# Altium schematic sheet PROM21参考.schdoc (continued)
## Nets (continued)
P3V3: D1.2(+) F1.A9(+3.3V) F1.A10(+3.3V) F1.B8(+3.3V) Q5.2(S) R89.2
P3V3_AUX: D2.2(+) F1.B10(+3.3Vaux)
P12V: C12.2 C13.2 C21.2 C22.2 C33.2 C34.2 C42.2 C43.2 C51.1 C52.2 C53.2 F1.A2(+12V) F1.A3(+12V) F1.B1(+12V) F1.B2(+12V) F1.B3(+12V) R55.2 R62.2 U2.3(VIN) U3.3(VIN) U3.5(EN) U5.3(VIN) U6.3(VIN) U7.2(VIN) U7.3(VIN) U7.4(VIN) U7.5(VIN)
VBUSA: C23.2 C24.2 C25.2 C26.2 C27.1 C28.1 C131.2 L2.2 R58.1 R107.1 R108.1 R109.1 R110.1 U11.12(VDD) USB1.1(VBUS) USB1.7(VBUS) USB1.11(VBUS)
VCC18: C44.2 C45.2 C46.2 C47.2 C48.1 C81.2 C82.2 C83.2 C84.2 C85.2 C86.2 C87.2 C88.2 C89.2 C90.2 L4.2 R65.2 R91.2 U8.A5(VCC18) U8.A6(VCC18) U8.B5(VCC18) U8.B6(VCC18) U8.C6(VCC18) U8.C7(VCC18) U8.D6(VCC18) U8.D7(VCC18) U8.E6(VCC18) U8.J9(VCC18) U8.J10(VCC18) U8.J11(VCC18) U8.J13(VCC18) U8.J14(VCC18) U8.J15(VCC18) U8.K9(VCC18) U8.K15(VCC18) U8.L9(VCC18) U8.L15(VCC18) U8.M9(VCC18) U8.M15(VCC18) U8.N15(VCC18) U8.P15(VCC18) U8.R9(VCC18) U8.R10(VCC18) U8.R11(VCC18) U8.R12(VCC18) U8.R13(VCC18) U8.R14(VCC18)
VCC33: C73.2 C74.2 C75.2 C76.2 LED1.2(A) LED2.2(A) LED3.2(A) LED4.2(A) Q1.2(E) Q2.2(E) Q5.3(D) R14.2 R16.2 R17.2 R20.2 R22.2 R24.2 R26.2 R28.2 R30.2 R32.2 R34.2 R36.2 R38.2 R40.2 R44.2 R45.2 R46.2 R47.2 R52.1 R67.2 R81.1 R92.2 R93.2 R111.2 R112.2 R113.2 U6.5(EN) U7.12(EN) U8.F10(VCC33) U8.F16(VCC33) U8.R18(VCC33)
VDD105: C55.2 C56.2 C57.2 C58.2 C59.1 C60.1 C103.2 C104.2 C105.2 C106.2 C107.2 C108.2 C109.2 C110.2 C111.2 C112.2 C113.2 C114.2 C115.2 C116.2 L5.2 R77.2 U8.J12(VDD105) U8.K10(VDD105) U8.K11(VDD105) U8.K13(VDD105) U8.K14(VDD105) U8.L10(VDD105) U8.L12(VDD105) U8.L14(VDD105) U8.M11(VDD105) U8.M13(VDD105) U8.N9(VDD105) U8.N10(VDD105) U8.N12(VDD105) U8.N14(VDD105) U8.P9(VDD105) U8.P10(VDD105) U8.P11(VDD105) U8.P13(VDD105) U8.P14(VDD105) U8.R1(VDD105) U8.R2(VDD105) U8.R3(VDD105) U8.R4(VDD105) U8.R5(VDD105) U8.R6(VDD105) U8.R15(VDD105) U8.T1(VDD105) U8.T2(VDD105) U8.T3(VDD105) U8.T4(VDD105) U8.T5(VDD105) U8.T6(VDD105)
VPP: C10.1 R51.2 R52.2 R53.2 R54.1 U1.8(VCC)
VSUS33: C30.2 C77.2 C78.2 D1.1(-) D2.1(-) R4.2 R5.2 R6.2 R7.2 R8.2 R9.2 R11.2 R13.2 R51.1 R66.2 U4.1(VIN) U4.3(EN) U8.P7(VSUS33)
VSUS105: C32.2 C79.2 C80.2 R60.2 R98.1 U4.6(VOUT) U8.U6(VSUS105)
1V05_PG: Q7.1(B) R91.1 U7.9(PGOOD)
ACT1: M.2-1.10(DAS_DSS#) R69.1
ACT2: M.2-2.10(DAS_DSS#) R70.1
C0+: C117.1 M.2-1.47(PETN0/SATA_A-)
C0-: C118.1 M.2-1.49(PETP0/SATA_A+)
C1+: C98.1 M.2-1.35(PETN1)
C1-: C100.1 M.2-1.37(PETP1)
C2+: C91.1 M.2-1.23(PETN2)
C2-: C92.1 M.2-1.25(PETP2)
C3+: C67.1 M.2-1.11(PETN3)
C3-: C68.1 M.2-1.13(PETP3)
C4+: C119.1 M.2-2.47(PETN0/SATA_A-)
C4-: C120.1 M.2-2.49(PETP0/SATA_A+)
C5+: C101.1 M.2-2.35(PETN1)
C5-: C102.1 M.2-2.37(PETP1)
C6+: C93.1 M.2-2.23(PETN2)
C6-: C94.1 M.2-2.25(PETP2)
C7+: C69.1 M.2-2.11(PETN3)
C7-: C70.1 M.2-2.13(PETP3)
CC1: R103.2 R105.2 USB1.8(CC1)
CC2: R104.2 R106.2 USB1.20(CC2)
CC_IND0: R113.1 U8.AB10(CC_IND_0) U11.11(DIR)
CLK0+: M.2-1.55(REFCLK+) U8.A21(CLK0+)
CLK0-: M.2-1.53(REFCLK-) U8.B21(CLK0-)
CLK1+: U8.A20(CLK1+)
CLK1-: U8.B20(CLK1-)
CLK2+: U8.A19(CLK2+)
CLK2-: U8.B19(CLK2-)
CLK3+: U8.D17(CLK3+)
CLK3-: U8.E17(CLK3-)
CLK4+: M.2-2.55(REFCLK+) U8.A18(CLK4+)
CLK4-: M.2-2.53(REFCLK-) U8.B18(CLK4-)
CLK5+: U8.A17(CLK5+)
CLK5-: U8.B17(CLK5-)
CLK_SRC: R16.1 R18.2 U8.E19(GPIO_R2*)  [also labelled GPIO_R2]
CLKREQ: R3.1 U8.A23(CLKREQ#)
CLKREQ0: M.2-1.52(CLKREQ#) R48.1 U8.AB22(GPIO18)
CLKREQ1: R44.1 U8.AA21(GPIO19)
CLKREQ2: R45.1 U8.V22(GPIO20)
CLKREQ3: R46.1 U8.AC21(GPIO21)
CLKREQ4: M.2-2.52(CLKREQ#) R49.1 U8.W22(GPIO22)
CLKREQ5: R47.1 U8.Y23(GPIO23)
DPE_RX0+: M.2-1.43(PERP0/SATA_B-) U8.K20(DPE_RX0+)
DPE_RX0-: M.2-1.41(PERN0/SATA_B+) U8.K19(DPE_RX0-)
DPE_RX1+: M.2-1.29(PERN1) U8.L20(DPE_RX1+)
DPE_RX1-: M.2-1.31(PERP1) U8.L19(DPE_RX1-)
DPE_RX2+: M.2-1.19(PERP2) U8.N20(DPE_RX2+)
DPE_RX2-: M.2-1.17(PERN2) U8.N19(DPE_RX2-)
DPE_RX3+: M.2-1.5(PERN3) U8.P20(DPE_RX3+)
DPE_RX3-: M.2-1.7(PERP3) U8.P19(DPE_RX3-)
DPE_RX4+: C66.1 U8.D8(DPE_RX4+)
DPE_RX4-: C64.1 U8.E8(DPE_RX4-)
DPE_RX5+: C99.1 U8.D9(DPE_RX5+)
DPE_RX5-: C97.1 U8.E9(DPE_RX5-)
DPE_RX6+: C124.1 U8.D11(DPE_RX6+)
DPE_RX6-: C123.1 U8.E11(DPE_RX6-)
DPE_RX7+: C130.1 U8.D12(DPE_RX7+)
DPE_RX7-: C129.1 U8.E12(DPE_RX7-)
DPE_RX8+: M.2-2.43(PERP0/SATA_B-) U8.D14(DPE_RX8+)
DPE_RX8-: M.2-2.41(PERN0/SATA_B+) U8.E14(DPE_RX8-)
DPE_RX9+: M.2-2.29(PERN1) U8.D15(DPE_RX9+)
DPE_RX9-: M.2-2.31(PERP1) U8.E15(DPE_RX9-)
DPE_RX10+: M.2-2.19(PERP2) U8.G20(DPE_RX10+)
DPE_RX10-: M.2-2.17(PERN2) U8.G19(DPE_RX10-)
DPE_RX11+: M.2-2.5(PERN3) U8.H20(DPE_RX11+)
DPE_RX11-: M.2-2.7(PERP3) U8.H19(DPE_RX11-)
DPE_TX0+: C118.2 U8.K22(DPE_TX0+)
DPE_TX0-: C117.2 U8.K23(DPE_TX0-)
DPE_TX1+: C100.2 U8.L22(DPE_TX1+)
DPE_TX1-: C98.2 U8.L23(DPE_TX1-)
DPE_TX2+: C92.2 U8.N22(DPE_TX2+)
DPE_TX2-: C91.2 U8.N23(DPE_TX2-)
DPE_TX3+: C68.2 U8.P22(DPE_TX3+)
DPE_TX3-: C67.2 U8.P23(DPE_TX3-)
DPE_TX4+: C61.1 U8.B8(DPE_TX4+)
DPE_TX4-: C62.1 U8.A8(DPE_TX4-)
DPE_TX5+: C95.1 U8.B9(DPE_TX5+)
DPE_TX5-: C96.1 U8.A9(DPE_TX5-)
DPE_TX6+: C121.1 U8.B11(DPE_TX6+)
DPE_TX6-: C122.1 U8.A11(DPE_TX6-)
DPE_TX7+: C127.1 U8.B12(DPE_TX7+)
DPE_TX7-: C128.1 U8.A12(DPE_TX7-)
DPE_TX8+: C120.2 U8.B14(DPE_TX8+)
DPE_TX8-: C119.2 U8.A14(DPE_TX8-)
DPE_TX9+: C102.2 U8.B15(DPE_TX9+)
DPE_TX9-: C101.2 U8.A15(DPE_TX9-)
DPE_TX10+: C94.2 U8.G22(DPE_TX10+)
DPE_TX10-: C93.2 U8.G23(DPE_TX10-)
DPE_TX11+: C70.2 U8.H22(DPE_TX11+)
DPE_TX11-: C69.2 U8.H23(DPE_TX11-)
EFUSE_PWR: U8.U20(EFUSE_PWR)
FAN_CTRL: R32.1 R35.2 U8.AB23(*FAN_CTRL)  [also labelled G1S1]
G0S0: R40.1 R42.2 U8.C2(*UART_TX)  [also labelled UART_TX]
G0S1: R38.1 R41.2 U1.2(SO) U8.A4(*SPI_SDI)  [also labelled SPI_SDI]
G0S2: R36.1 R39.2 U1.5(SI) U8.E2(*SPI_SDO)  [also labelled SPI_SDO]
G1S0: R34.1 R37.2 U8.E18(GPIO_R1*)  [also labelled GPIO_R1]
G1S2: R30.1 R33.2 U8.A22(*INT)  [also labelled GPIO_INT]
G2S0: R28.1 R31.2 U1.6(SCK) U8.A1(*SPI_SCL)  [also labelled SPI_SCK]
G2S1: R26.1 R29.2 U8.C1(GPIO_R9*)  [also labelled GPIO_R9]
G2S2: R24.1 R27.2 U8.B1(GPIO_R8*)  [also labelled GPIO_R8]
GPIO0: U8.B3(GPIO0)
GPIO1: U8.C4(GPIO1)
GPIO2: U8.A2(GPIO2)
GPIO3: U8.D3(GPIO3)
GPIO4: U8.D2(GPIO4)
GPIO5: U8.B4(GPIO5)
GPIO6: U8.C3(GPIO6)
GPIO7: U8.D4(GPIO7)
GPIO8: U8.D22(GPIO8)
GPIO9: U8.B22(GPIO9)
GPIO10: U8.C23(GPIO10)
GPIO11: U8.C19(GPIO11)
GPIO12: U8.D19(GPIO12)
GPIO13: U8.AB21(GPIO13)
GPIO14: U8.Y21(GPIO14)
GPIO15: U8.V20(GPIO15)
GPIO16: U8.V21(GPIO16)
GPIO17: U8.AA23(GPIO17)
GPIO_R0: U8.E20(GPIO_R0)
GPIO_R3: R17.1 R21.2 U8.D20(GPIO_R3*)  [also labelled USB_SSC_EN]
GPIO_R4: R20.1 R23.2 U8.B23(GPIO_R4*)  [also labelled SATA_SSC_EN]
GPIO_R5: R22.1 R25.2 U8.D18(GPIO_R5*)  [also labelled PCIE_SSC_EN]
GPIO_R6: U8.D21(GPIO_R6)
GPIO_R7: U8.C22(GPIO_R7)
IFDET0: R10.1 U8.E3(IFDET0)
IFDET1: R12.1 U8.E4(IFDET1)
INT: R81.2 U8.V23(INT)
M2_RST: M.2-1.50(PERST#) M.2-2.50(PERST#) Q4.3(D) R67.1
PERST: R2.1 U8.AC5(PERST)
PEWAKE: R1.1 U8.AC6(PEWAKE)
PON0: U8.AC10(PPON_0)
PON1: U8.AB9(PPON_2)
PON2: U8.AB8(PPON_2)
PON3: U8.AB7(PPON_3)
PON4: U8.W8(PPON_4)
PON5: U8.AA6(PPON_5)
PON6: U8.W6(PPON_6)
PON7: U8.AA5(PPON_7)
PON8: U8.Y8(PPON_8)
PON9: U8.AB6(PPON_9)
PON10: U8.Y7(PPON_10)
PON11: R14.1 R19.2 U8.AB5(PPON_11)
PREXT: R50.2 U8.D23(PREXT)
PWR_GD: C126.2 Q8.3(D) R93.1 U8.U22(PWR_GD)
REFCLK+: F1.A13(REFCLKp) U8.E22(UPE_CLK0-)
REFCLK-: F1.A14(REFCLKn) U8.E23(UPE_CLK+)
RST: Q3.1(G) U8.AC7(RST)
S0+: C61.2 CN1.2
S0-: C62.2 CN1.3
S1+: C64.2 CN1.5
S1-: C66.2 CN1.6
S2+: C95.2 CN2.2
S2-: C96.2 CN2.3
S3+: C97.2 CN2.5
S3-: C99.2 CN2.6
S4+: C121.2 CN3.2
S4-: C122.2 CN3.3
S5+: C123.2 CN3.5
S5-: C124.2 CN3.6
S6+: C127.2 CN4.2
S6-: C128.2 CN4.3
S7+: C129.2 CN4.5
S7-: C130.2 CN4.6
SATA_LED0: R71.1 U8.A3(SATALED0)
SATA_LED1: R72.1 U8.C5(SATALED1)
SATA_LED2: R75.1 U8.E5(SATALED2)
SATA_LED3: R76.1 U8.D1(SATALED3)
SMI: U8.D5(SMI)
SPI_CS: U1.1(CS#) U8.E1(SPI_CS)
SS0_RX+: U8.W12(SS_RXP0) USB1.5(RX1+)
SS0_RX-: U8.Y12(SS_RXN0) USB1.6(RX1-)
SS0_TX+: C63.1 U8.AB12(SS_TXP0)
SS0_TX-: C65.1 U8.AC12(SS_TXN0)
SS1_RX+: U8.Y13(SS_RXP1) USB1.16(RX2-)
SS1_RX-: U8.W13(SS_RXN1) USB1.15(RX2+)
SS1_TX+: C49.1 U8.AC13(SS_TXP1)
SS1_TX-: C50.1 U8.AB13(SS_TXN1)
SS2_RX+: U8.W15(SS_RXP2)
SS2_RX-: U8.Y15(SS_RXN2)
SS2_TX+: U8.AB15(SS_TXP2)
SS2_TX-: U8.AC15(SS_TXN2)
SS3_RX+: U8.W16(SS_RXP3)
SS3_RX-: U8.Y16(SS_RXN3)
SS3_TX+: U8.AB16(SS_TXP3)
SS3_TX-: U8.AC16(SS_TXN3)
SS4_RX+: U8.W18(SS_RXP4)
SS4_RX-: U8.Y18(SS_RXN4)
SS4_TX+: U8.AB18(SS_TXP4)
SS4_TX-: U8.AC18(SS_TXN4)
SS5_RX+: U8.W19(SS_RXP5)
SS5_RX-: U8.Y19(SS_RXN5)
SS5_TX+: U8.AB19(SS_TXP5)
SS5_TX-: U8.AC19(SS_TXN5)
STATUS0: R111.1 R114.1 U8.AA10(STATUS_IND_0)
STATUS1: R112.1 R115.1 U8.Y10(STATUS_IND2_0)
TACH_IN: U8.AC22(TACH_IN)
TCK: U8.W23(*TCK)
TDI: U8.AC23(TDI)
TDO: U8.AA22(*TDO)
TMS: U8.W21(TMS)
TRST: R43.2 U8.Y22(RTCK)
U3C0+: C65.2 USB1.2(TX1+)
U3C0-: C63.2 USB1.3(TX1-)
U3C1+: C49.2 USB1.12(TX2+)
U3C1-: C50.2 USB1.13(TX2-)
UART_RX: U8.B2(UART_RX)
UPE_RX0+: F1.B15(PERn0) U8.G4(UPE_RX0+)
UPE_RX0-: F1.B14(PERp0) U8.G5(UPE_RX0-)
UPE_RX1+: F1.B20(PERn1) U8.J4(UPE_RX1+)
UPE_RX1-: F1.B19(PERp1) U8.J5(UPE_RX1-)
UPE_RX2+: F1.B24(PERn2) U8.L4(UPE_RX2+)
UPE_RX2-: F1.B23(PERp2) U8.L5(UPE_RX2-)
UPE_RX3+: F1.B28(PERn3) U8.N4(UPE_RX3+)
UPE_RX3-: F1.B27(PERp3) U8.N5(UPE_RX3-)
UPE_TX0+: C2.2 U8.G2(UPE_TX0+)
UPE_TX0-: C3.2 U8.G1(UPE_TX0-)
UPE_TX1+: C4.2 U8.J2(UPE_TX1+)
UPE_TX1-: C5.2 U8.J1(UPE_TX1-)
UPE_TX2+: C6.2 U8.L2(UPE_TX2+)
UPE_TX2-: C7.2 U8.L1(UPE_TX2-)
UPE_TX3+: C8.2 U8.N2(UPE_TX3+)
UPE_TX3-: C9.2 U8.N1(UPE_TX3-)
UREXT: R15.1 U8.U23(UREXT)
USB0_D+: U8.U1(HSDP0) USB1.19(D+)
USB0_D-: U8.U2(HSDN0) USB1.18(D-)
USB1_D+: U8.U5(HSDP1)
USB1_D-: U8.U4(HSDN1)
USB2_D+: U8.V2(HSDP2)
USB2_D-: U8.W1(HSDN2)
USB3_D+: U8.V3(HSDP3)
USB3_D-: U8.V4(HSDN3)
USB4_D+: U8.Y1(HSDP4)
USB4_D-: U8.W2(HSDN4)
USB5_D+: U8.AA2(HSDP5)
USB5_D-: U8.AA1(HSDN5)
USB6_D+: U8.Y3(HSDP6)
USB6_D-: U8.W3(HSDN6)
USB7_D+: U8.AB1(HSDP7)
USB7_D-: U8.AB2(HSDN7)
USB8_D+: U8.Y4(HSDP8)
USB8_D-: U8.Y5(HSDN8)
USB9_D+: U8.AA4(HSDP9)
USB9_D-: U8.AA3(HSDN9)
USB10_D+: U8.AC3(HSDP10)
USB10_D-: U8.AC2(HSDN10)
USB11_D+: U8.AB4(HSDP11)
USB11_D-: U8.AC4(HSDN11)
USB_OC0: R4.1 U8.AC9(USB_OC0)
USB_OC1: R5.1 U8.W7(USB_OC1)
USB_OC2: R6.1 U8.Y6(USB_OC2)
USB_OC3: R7.1 U8.AC8(USB_OC3)
USB_OC4: R8.1 U8.Y9(USB_OC4)
USB_OC5: R9.1 U8.AA8(USB_OC5)
USB_OC6: R11.1 U8.AA7(USB_OC6)
USB_OC7: R13.1 U8.AA9(USB_OC7)
VTEST: U8.E21(V_TEST)
X1: C1.2 U8.T22(X1) X1.3(OSC2)
X2: C1.1 U8.T23(X2) X1.1(OSC1)
NetC11_1: C11.1 L1.1 U2.2(SW)
NetC11_2: C11.2 U2.6(VBST)
NetC14_1: C14.1 L2.1 U3.2(SW)
NetC14_2: C14.2 U3.6(VBST)
NetC29_1: C29.1 L3.1 U5.2(SW)
NetC29_2: C29.2 U5.6(VBST)
NetC31_2: C31.2 U4.4(BP)
NetC41_1: C41.1 L4.1 U6.2(SW)
NetC41_2: C41.2 U6.6(VBST)
NetC54_1: C54.1 U7.1(BST)
NetC54_2: C54.2 L5.1 U7.6(SW) U7.19(SW) U7.20(SW)
NetC71_2: C71.2 R78.1 U7.17(VCC)
NetC72_2: C72.2 U7.11(SS)
NetC125_2: C125.2 Q6.1(B) R98.2
NetF1_A11: F1.A11(PERST#) R2.2
NetF1_B11: F1.B11(WAKE#) R1.2
NetF1_B12: F1.B12(CLKREQ#) R3.2
NetLED1_1: LED1.1(K) R71.2
NetLED2_1: LED2.1(K) R72.2
NetLED3_1: LED3.1(K) R75.2
NetLED4_1: LED4.1(K) R76.2
NetLED5_2: LED5.2(A) R73.1
NetLED6_2: LED6.2(A) R74.1
NetQ1_1: Q1.1(B) R69.2
NetQ1_3: Q1.3(C) R73.2
NetQ2_1: Q2.1(B) R70.2
NetQ2_3: Q2.3(C) R74.2
NetQ3_3: Q3.3(D) Q4.1(G) R66.1
NetQ5_1: Q5.1(G) Q6.3(C) R89.1
NetQ7_3: Q7.3(C) Q8.1(G) R92.1
NetR53_1: R53.1 U1.3(WP#)
NetR54_2: R54.2 U1.7(HOLD#)
NetR55_1: R55.1 U2.5(EN)
NetR56_1: R56.1 R57.1 U2.4(VFB)
NetR58_2: R58.2 R59.2 U3.4(VFB)
NetR60_1: R60.1 R61.2 U4.5(ADJ)
NetR62_1: R62.1 U5.5(EN)
NetR63_1: R63.1 R64.1 U5.4(VFB)
NetR65_1: R65.1 R68.1 U6.4(VFB)
NetR77_1: R77.1 R79.2 U7.14(FB)
NetR78_2: R78.2 R80.2 U7.15(MODE)
NetR103_1: R103.1 R104.1 U11.1(CC1)
NetR105_1: R105.1 R106.1 U11.2(CC2)
NetR107_2: R107.2 U11.4(PORT)
NetR108_2: R108.2 U11.3(CURRENT_MODE)
NetR109_2: R109.2 U11.5(VBUS_DET)
NetR110_2: R110.2 U11.6(VCONN_FAULT)
NetR114_2: R114.2 R115.2 U11.9(ID)

Not connected (* = marked no-connect by the designer): F1 A5(JTAG2)* A6(JTAG3)* A7(JTAG4)* A8(JTAG5)* A19(RVSD)* A32(RVSD)* B5(SMBCLK) B6(SMBDAT) B9(JTAG1)* B30(PWRBRK#)*; M.2-1 6(NC1) 8(NC2) 20(NC3) 22(NC4) 24(NC5) 26(NC6) 28(NC7) 30(NC8) 32(NC9) 34(NC10) 36(NC11) 38(DEVSLP) 40(NC12) 42(NC13) 44(NC14) 46(NC15) 48(NC16) 54(PEWAKE#) 56(NC17) 58(NC18) 67(NC19) 68(SUSCLK) 69(PEDET); M.2-2 6(NC1) 8(NC2) 20(NC3) 22(NC4) 24(NC5) 26(NC6) 28(NC7) 30(NC8) 32(NC9) 34(NC10) 36(NC11) 38(DEVSLP) 40(NC12) 42(NC13) 44(NC14) 46(NC15) 48(NC16) 54(PEWAKE#) 56(NC17) 58(NC18) 67(NC19) 68(SUSCLK) 69(PEDET); U11 7(OUT1)* 8(OUT2)*; USB1 9(SBU1)* 10(SBU2)*

## Notes on the sheet
- (near U8) ?
- (near U8) FAN?
- (near U8) JTAG
- (near U8) UART
- (near U8) SPI
- 218-0891018
- USB3.2GEN2X2
- 1
- 2
- 3
- 4
- 5
- 6
- A
- B
- C
- D
- 更新日期
- 2025-06-21
- 原理图
- 图页
- Schematic1_1
- P1
- 创建日期
- 物料编码
- 2025-04-14
- 审阅
- 绘制
- PROM21
- 版本
- V1.0
- 尺寸
- A4
- 页
- 嘉立创EDA
- 共
- (in symbol 91302-42-067RDM) KEY
- (in symbol Gold Finger PCIEX4) KEY
- (in symbol PROM21, part A) UPStream; Promontory 21
- (in symbol PROM21, part B) PCIE&SATA; Promontory 21; PCIE Gen4; PCIE Gen3; SATA
- (in symbol PROM21, part C) USB; Promontory 21
- (in symbol PROM21, part D) GPIO; Promontory 21
- (in symbol PROM21, part E) Power; Promontory 21
- (in symbol PROM21, part F) Promontory 21

## Library data of the parts
C1 = 0402CG150J500NT: 容值:15pF;精度:±5%;额定电压:50V;材质(温度系数):C0G;; Manufacturer: FH(风华); AddInBom: yes; ModelId: 36a51122f27c49738f86b3bfa98863e0; ModelName: C0402_L1.0-W0.5-H0.5; ModelTransform: 39.37,19.685,0,0,0,0,0,0,0; Tolerance: ±5%; Voltage Rated: 50V; Temperature Coefficient: C0G; Symbol: 0402CG150J500NT; Device: 0402CG150J500NT; Supplier: LCSC; Manufacturer Part: 0402CG150J500NT; Capacitance: 15pF; Supplier Part: C1548; JLCPCB Part Class: Basic Part; LCSC Part Name: 15pF ±5% 50V; Supplier Footprint: 0402; Datasheet: https://atta.szlcsc.com/upload/public/pdf/source/20200305/C486355_26A10D38EF8C2A5C37091D0039909270.pdf; ConvertToPcb: yes; FootprintName: C0402; Value: 15pF
C2-C10 C49 C50 C54 C63 C65 C67-C70 C91-C94 C98 C100-C102 C117-C120 = CL05B224KO5NNNC: 容值:220nF;精度:±10%;额定电压:16V;材质(温度系数):X7R;; Manufacturer: SAMSUNG(三星); AddInBom: yes; ModelId: 36a51122f27c49738f86b3bfa98863e0; ModelName: C0402_L1.0-W0.5-H0.5; ModelTransform: 39.37,19.685,0,0,0,0,0,0,0; Tolerance: ±10%; Voltage Rated: 16V; Temperature Coefficient: X7R; Symbol: CL05B224KO5NNNC; Device: CL05B224KO5NNNC; Supplier: LCSC; Manufacturer Part: CL05B224KO5NNNC; Value: 220nF; Supplier Part: C16772; JLCPCB Part Class: Basic Part; LCSC Part Name: 220nF ±10% 16V; Supplier Footprint: 0402; Datasheet: https://atta.szlcsc.com/upload/public/pdf/source/20160218/1457707763339.pdf; ConvertToPcb: yes
  C2-C9 C67-C70 C91-C94 C98 C100-C102 C117-C120: FootprintName: C0402_BGA
  C10 C49 C50 C63 C65: FootprintName: C0402
  C54: FootprintName: C0402_1
C11 C14 C29 C41 C75 C76 C78 C80 C82-C90 C105-C116 C131 = CL05B104KO5NNNC: 容值:100nF;精度:±10%;额定电压:16V;材质(温度系数):X7R;; Manufacturer: SAMSUNG(三星); AddInBom: yes; ModelId: 36a51122f27c49738f86b3bfa98863e0; ModelName: C0402_L1.0-W0.5-H0.5; ModelTransform: 39.37,19.685,0,0,0,0,0,0,0; Tolerance: ±10%; Voltage Rated: 16V; Temperature Coefficient: X7R; Supplier: LCSC; Value: 100nF; JLCPCB Part Class: Basic Part; Symbol: CL05B104KO5NNNC; Device: CL05B104KO5NNNC; LCSC Part Name: 100nF ±10% 16V; Supplier Footprint: 0402; ConvertToPcb: yes
  C11 C14 C29 C41: Manufacturer Part: CL05B104KO5NNNC; Supplier Part: C1525; Datasheet: https://atta.szlcsc.com/upload/public/pdf/source/20160218/1457707763339.pdf; FootprintName: C0402
  C75 C76 C78 C80 C82-C90 C105-C116 C131: SupplierPart: C1525; ManufacturerPart: CL05B104KO5NNNC; Datasheet: https://atta.szlcsc.com/upload/public/pdf/source/20160103/1457707674891.pdf; FootprintName: C0402_BGA
C12 C13 C33 C34 = CL21A106KAYNNNE_C15850: 容值:10uF;精度:±10%;额定电压:25V;材质(温度系数):X5R;; Manufacturer: SAMSUNG(三星); Symbol: CL31A226KAHNNNE; AddInBom: yes; ModelId: 1ba041120af144c991958decab20d241; ModelName: C0805_L2.0-W1.3-H1.3; ModelTransform: 78.74,51.181,0,0,0,0,0,0.0005,0; Tolerance: ±10%; Voltage Rated: 25V; Temperature Coefficient: X5R; JLCPCB Part Class: Basic Part; Device: CL21A106KAYNNNE_C15850; Supplier: LCSC; Manufacturer Part: CL21A106KAYNNNE; Value: 10uF; Supplier Part: C15850; LCSC Part Name: 10uF ±10% 25V; Supplier Footprint: 0805; Datasheet: https://atta.szlcsc.com/upload/public/pdf/source/20160218/1457707763339.pdf; ConvertToPcb: yes; FootprintName: C0805_1
C15-C20 C23-C26 C30 C32 C35-C40 C44-C47 = CL21A226MAQNNNE: 容值:22uF;精度:±20%;额定电压:25V;材质(温度系数):X5R;; Manufacturer: SAMSUNG(三星); Symbol: GRM188B30J226MEA0D; AddInBom: yes; ModelId: 1ba041120af144c991958decab20d241; ModelName: C0805_L2.0-W1.3-H1.3; ModelTransform: 78.74,51.181,0,0,0,0,0,0.0005,0; Tolerance: ±20%; Voltage Rated: 25V; Temperature Coefficient: X5R; Device: CL21A226MAQNNNE; Supplier: LCSC; Manufacturer Part: CL21A226MAQNNNE; Value: 22uF; Supplier Part: C45783; JLCPCB Part Class: Basic Part; LCSC Part Name: 22uF ±20% 25V; Supplier Footprint: 0805; Datasheet: https://atta.szlcsc.com/upload/public/pdf/source/20160218/1457707763339.pdf; ConvertToPcb: yes; FootprintName: C0805
C21 C22 C42 C43 C52 C53 = CL31A226KAHNNNE: 容值:22uF;精度:±10%;额定电压:25V;材质(温度系数):X5R;; Manufacturer: SAMSUNG(三星); AddInBom: yes; ModelId: e4be705b945545a48e666415e3682bd8; ModelName: C1206_L3.2-W1.6-H1.3; ModelTransform: 125.984,62.992,0,0,0,0,0,0,0; Tolerance: ±10%; Voltage Rated: 25V; Temperature Coefficient: X5R; JLCPCB Part Class: Basic Part; Symbol: CL31A226KAHNNNE; Device: CL31A226KAHNNNE; Supplier: LCSC; Manufacturer Part: CL31A226KAHNNNE; Value: 22uF; Supplier Part: C12891; LCSC Part Name: 22uF ±10% 25V; Supplier Footprint: 1206; Datasheet: https://atta.szlcsc.com/upload/public/pdf/source/20160218/1457707763339.pdf; ConvertToPcb: yes; FootprintName: C1206
C27 C28 C48 C59 C60 = 6TPE220MAZB: 容值:220uF;精度:±20%;额定电压:6.3V;等效串联电阻:35mΩ@100kHz;; Manufacturer: PANASONIC(松下); AddInBom: yes; ModelId: 0dfcda272f9b43668c6086d3a08712ba; ModelName: CASE-B_L3.5-W2.8-H1.9; ModelTransform: 145.669,110.236,0,180,0,0,0,0,0; Tolerance: ±20%; Rated Voltage: 6.3V; Symbol: 6TPE220MAZB; Device: 6TPE220MAZB; LCSC Part Name: 220uF ±20% 6.3V; SupplierPart: C79111; ManufacturerPart: 6TPE220MAZB; Supplier Footprint: -; JLCPCB Part Class: 扩展库; Datasheet: https://atta.szlcsc.com/upload/public/pdf/source/20180301/C178383_15198943937361383951.pdf; Supplier: LCSC; ConvertToPcb: yes; FootprintName: CAP-SMD_L3.5-W2.8-R-RD; Value: 220uF; Equivalent Series Resistance(ESR): 35mΩ@100kHz; Operating Temperature: -55℃~+105℃
C31 = 0402B223K500NT: 容值:22nF;精度:±10%;额定电压:50V;材质(温度系数):X7R;; Manufacturer: FH(风华); AddInBom: yes; ModelId: 36a51122f27c49738f86b3bfa98863e0; ModelName: C0402_L1.0-W0.5-H0.5; ModelTransform: 39.37,19.685,0,0,0,0,0,0,0; Tolerance: ±10%; Voltage Rated: 50V; Temperature Coefficient: X7R; Symbol: 0402B223K500NT; Device: 0402B223K500NT; LCSC Part Name: 22nF ±10% 50V; SupplierPart: C1532; ManufacturerPart: 0402B223K500NT; Supplier Footprint: 0402; JLCPCB Part Class: 基础库; Datasheet: https://atta.szlcsc.com/upload/public/pdf/source/20200305/C486355_26A10D38EF8C2A5C37091D0039909270.pdf; Supplier: LCSC; ConvertToPcb: yes; FootprintName: C0402; Value: 22nF
C51 = PM101M016E058PTR: 容值:100uF;精度:±20%;额定电压:16V;; Manufacturer: CapXon(丰宾); AddInBom: yes; ModelId: 1f98774f34d342b59c9890c435f425a3; ModelTransform: 283.464,259.842,0,180,0,0,0,0,0; Tolerance: ±20%; Rated Voltage: 16V; Symbol: PM101M016E058PTR; Device: PM101M016E058PTR; LCSC Part Name: 100uF ±20% 16V; SupplierPart: C2858381; ManufacturerPart: PM101M016E058PTR; Supplier Footprint: SMD,5.8x6.3mm; JLCPCB Part Class: 扩展库; Datasheet: https://atta.szlcsc.com/upload/public/pdf/source/20220817/9A861094B5C60785B8FD85574FC96B21.pdf; Supplier: LCSC; ConvertToPcb: yes; FootprintName: CAP-SMD_BD6.3-L6.6-W6.6-LS7.2-FD; ModelName: CAP-SMD_BD6.3-L6.6-W6.6-LS7.2-FD; Value: 100uF
C55-C58 = CL21A226MAQNNNE: 容值:22uF;精度:±20%;额定电压:25V;材质(温度系数):X5R;; Manufacturer: SAMSUNG(三星); Symbol: CL21A476MQYNNNE; AddInBom: yes; ModelId: 1ba041120af144c991958decab20d241; ModelName: C0805_L2.0-W1.3-H1.3; ModelTransform: 78.74,51.181,0,0,0,0,0,0.0005,0; Tolerance: ±20%; Voltage Rated: 25V; Temperature Coefficient: X5R; Device: CL21A226MAQNNNE; LCSC Part Name: 22uF ±20% 25V; SupplierPart: C45783; ManufacturerPart: CL21A226MAQNNNE; Supplier Footprint: 0805; JLCPCB Part Class: Basic Part; Datasheet: https://atta.szlcsc.com/upload/public/pdf/source/20160218/1457707763339.pdf; Supplier: LCSC; ConvertToPcb: yes; FootprintName: C0805; Value: 22uF
C61 C62 C64 C66 C95-C97 C99 C121-C124 C127-C130 = CC0402KRX7R9BB103: 容值:10nF;精度:±10%;额定电压:50V;材质(温度系数):X7R;; Manufacturer: YAGEO(国巨); AddInBom: yes; ModelId: 36a51122f27c49738f86b3bfa98863e0; ModelName: C0402_L1.0-W0.5-H0.5; ModelTransform: 39.37,19.685,0,0,0,0,0,0,0; Tolerance: ±10%; Voltage Rated: 50V; Temperature Coefficient: X7R; Device: CC0402KRX7R9BB103; Symbol: CC0402KRX7R9BB103; LCSC Part Name: 10nF ±10% 50V; SupplierPart: C60133; ManufacturerPart: CC0402KRX7R9BB103; Supplier Footprint: 0402; JLCPCB Part Class: Extended Part; Datasheet: https://atta.szlcsc.com/upload/public/pdf/source/20151201/1457707601869.pdf; Supplier: LCSC; ConvertToPcb: yes; FootprintName: C0402; Value: 10nF
C71 = CL10A225KO8NNNC: 容值:2.2uF;精度:±10%;额定电压:16V;材质(温度系数):X5R;; Manufacturer: SAMSUNG(三星); AddInBom: yes; ModelId: ac125912035d415993ca9572d50418b1; ModelName: C0603_L1.6-W0.8-H0.8; ModelTransform: 62.992,31.496,0,0,0,0,0,0,0; Tolerance: ±10%; Voltage Rated: 16V; Temperature Coefficient: X5R; JLCPCB Part Class: Basic Part; Symbol: CL10A225KO8NNNC; Device: CL10A225KO8NNNC; Supplier: LCSC; Manufacturer Part: CL10A225KO8NNNC; Value: 2.2uF; Supplier Part: C23630; LCSC Part Name: 2.2uF ±10% 16V; Supplier Footprint: 0603; Datasheet: https://atta.szlcsc.com/upload/public/pdf/source/20160218/1457707763339.pdf; ConvertToPcb: yes; FootprintName: C0603
C72 = CL05B103KB5NNNC: 容值:10nF;精度:±10%;额定电压:50V;材质(温度系数):X7R;; Manufacturer: SAMSUNG(三星); Symbol: CC0402KRX7R9BB103; AddInBom: yes; ModelId: 36a51122f27c49738f86b3bfa98863e0; ModelName: C0402_L1.0-W0.5-H0.5; ModelTransform: 39.37,19.685,0,0,0,0,0,0,0; Tolerance: ±10%; Voltage Rated: 50V; Temperature Coefficient: X7R; Device: CL05B103KB5NNNC; LCSC Part Name: 10nF ±10% 50V; SupplierPart: C15195; ManufacturerPart: CL05B103KB5NNNC; Supplier Footprint: 0402; JLCPCB Part Class: Basic Part; Datasheet: https://atta.szlcsc.com/upload/public/pdf/source/20160218/1457707763339.pdf; Supplier: LCSC; ConvertToPcb: yes; FootprintName: C0402; Value: 10nF
C73 C74 C77 C79 C81 C103 C104 = CL10A106KP8NNNC: 容值:10uF;精度:±10%;额定电压:10V;材质(温度系数):X5R;; Manufacturer: SAMSUNG(三星); AddInBom: yes; ModelId: ac125912035d415993ca9572d50418b1; ModelName: C0603_L1.6-W0.8-H0.8; ModelTransform: 62.992,31.496,0,0,0,0,0,0,0; Tolerance: ±10%; Voltage Rated: 10V; Temperature Coefficient: X5R; Symbol: CL10A106KP8NNNC; Device: CL10A106KP8NNNC; Supplier: LCSC; Manufacturer Part: CL10A106KP8NNNC; Value: 10uF; Supplier Part: C19702; JLCPCB Part Class: 基础库; LCSC Part Name: 10uF ±10% 10V; Supplier Footprint: 0603; Datasheet: https://atta.szlcsc.com/upload/public/pdf/source/20160218/1457707763339.pdf; ConvertToPcb: yes; FootprintName: C0603
C125 C126 = CL10A105KB8NNNC: 容值:1uF;精度:±10%;额定电压:50V;材质(温度系数):X5R;; Manufacturer: SAMSUNG(三星); AddInBom: yes; ModelId: ac125912035d415993ca9572d50418b1; ModelName: C0603_L1.6-W0.8-H0.8; ModelTransform: 62.992,31.496,0,0,0,0,0,0,0; Tolerance: ±10%; Voltage Rated: 50V; Temperature Coefficient: X5R; Symbol: CL10A105KB8NNNC; Device: CL10A105KB8NNNC; LCSC Part Name: 1uF ±10% 50V; SupplierPart: C15849; ManufacturerPart: CL10A105KB8NNNC; Supplier Footprint: 0603; JLCPCB Part Class: 基础库; Datasheet: https://atta.szlcsc.com/upload/public/pdf/source/20160218/1457707763339.pdf; Supplier: LCSC; ConvertToPcb: yes; FootprintName: C0603; Value: 1uF
CN1-CN4 = HYCW02-SATA07-250B: SATA三面包90度鱼叉脚; Manufacturer: 华宇创; AddInBom: yes; ModelId: 56bd21e6863d4432a19176bfb4d42780; ModelTransform: 687.79386,452.755,0,0,0,0,0.001,-146.653,-106.299; Symbol: HYCW02-SATA07-250B; Device: HYCW02-SATA07-250B; LCSC Part Name: 7P 1.27mm; SupplierPart: C2926811; ManufacturerPart: HYCW02-SATA07-250B; Supplier Footprint: SMD,P=1.27mm; JLCPCB Part Class: 扩展库; Datasheet: https://atta.szlcsc.com/upload/public/pdf/source/20211209/0D435786836D1B046884423628DE4302.pdf; Supplier: LCSC; ConvertToPcb: yes; FootprintName: CONN-SMD_7P-P1.27_HYC_HYCW02-SATA07-250B; ModelName: CONN-SMD_7P-P1.27_HYC_HYCW02-SATA07-250B
D1 D2 = B5819W SL: 正向压降(Vf):600mV@1A;直流反向耐压(Vr):40V;整流电流:1A;; Manufacturer: CJ(江苏长电/长晶); Symbol: B5819W_C8598; AddInBom: yes; ModelId: 528459655f7d4601a76356f3191c812b; ModelTransform: 151.575,66.929,0,0,0,0,0,0,0; Reverse Voltage (Vr): 40V; Rectified Current: 1A; Device: B5819W SL; LCSC Part Name: 电压:40V 电流:1A; SupplierPart: C8598; ManufacturerPart: B5819W SL; Supplier Footprint: SOD-123; JLCPCB Part Class: 基础库; Datasheet: https://atta.szlcsc.com/upload/public/pdf/source/20171228/C164911_15144413243851213914.pdf; Supplier: LCSC; ConvertToPcb: yes; FootprintName: SOD-123_L2.7-W1.6-LS3.7-RD-1; ModelName: SOD-123_L2.7-W1.6-LS3.7-RD-1; Forward Voltage (Vf@If): 600mV@1A
F1 = Gold Finger PCIEX4: Add into BOM: no; ConvertToPcb: yes; Device: Gold Finger PCIEX4; SymbolName: Gold Finger PCIEX4; FootprintName: Gold Finger PCIEX4
L1 L3 = APH0630T2R2M: 电感值:2.2uH;精度:±20%;额定电流:8.65A;饱和电流(Isat):8.3A;类型:一体成型电感;; Manufacturer: APV(爱普微); Symbol: XR0630-3R3M; AddInBom: yes; ModelId: afd9a109199c403889596ac71b7d6c8f; ModelName: IND-SMD_L7.0-W6.6-H5.0_MCW-0650-220; ModelTransform: 273.6215,259.842,0,0,0,0,0,0,0; Tolerance: ±20%; Rated Current: 8.65A; Saturation Current (Isat): 8.3A; DC Resistance (DCR): 15mΩ; Type: 一体成型电感; Device: APH0630T2R2M; LCSC Part Name: 2.2uH ±20% 8.3A; SupplierPart: C5349701; ManufacturerPart: APH0630T2R2M; Supplier Footprint: SMD,7x6.6mm; JLCPCB Part Class: Extended Part; Datasheet: https://atta.szlcsc.com/upload/public/pdf/source/20240422/44C6AF90C0CE08E50D7C2708B16BB974.pdf; Supplier: LCSC; ConvertToPcb: yes; FootprintName: IND-SMD_L7.0-W6.6_MCW-0650-220; Value: 2.2uH; Ratings: -
L2 = PSPMAA0803H-4R7M-ANP: 电感值:4.7uH;精度:±20%;额定电流:6.5A;饱和电流(Isat):11A;; Manufacturer: PROD(谱罗德); Symbol: MPB252010T-2R2M-NA2; AddInBom: yes; ModelId: d96e88baa8444abf941beb1907359016; ModelTransform: 334.645,315.3537,0,0,0,0,0,0,0; Tolerance: ±20%; Rated Current: 6.5A; Saturation Current (Isat): 11A; DC Resistance (DCR): 32mΩ; Device: PSPMAA0803H-4R7M-ANP; LCSC Part Name: 4.7uH ±20% 11A; SupplierPart: C3036138; ManufacturerPart: PSPMAA0803H-4R7M-ANP; Supplier Footprint: SMD,8.0x8.5mm; JLCPCB Part Class: Extended Part; Datasheet: https://atta.szlcsc.com/upload/public/pdf/source/20220615/6D229EC78B1C4164BD1E169383CB3085.pdf; Supplier: LCSC; ConvertToPcb: yes; FootprintName: IND-SMD_L8.5-W8.0_PSPMAA0803H-330M-ANP; ModelName: IND-SMD_L8.5-W8.0_PSPMAA0803H-330M-ANP; Value: 4.7uH; Ratings: AEC-Q200
L4 = APH0530T2R2M: 电感值:2.2uH;精度:±20%;额定电流:6.49A;饱和电流(Isat):5.81A;类型:一体成型电感;; Manufacturer: APV(爱普微); Symbol: MPB252010T-2R2M-NA2; AddInBom: yes; ModelId: 8cf4ba96105a43709c0ba3ecbf611559; ModelName: IND-SMD_L5.4-W5.2-H3.0; ModelTransform: 212.598,204.724,0,0,0,0,0,0,0; Tolerance: ±20%; Rated Current: 6.49A; Saturation Current (Isat): 5.81A; DC Resistance (DCR): 29mΩ; Type: 一体成型电感; Device: APH0530T2R2M; LCSC Part Name: 2.2uH ±20% 5.81A; SupplierPart: C5349681; ManufacturerPart: APH0530T2R2M; Supplier Footprint: SMD,5.4x5.2mm; JLCPCB Part Class: Extended Part; Datasheet: https://atta.szlcsc.com/upload/public/pdf/source/20230920/8DF4F91CA8787177DE496A10F73889DA.pdf; Supplier: LCSC; ConvertToPcb: yes; FootprintName: IND-SMD_L5.4-W5.2; Value: 2.2uH; Ratings: -
L5 = APH0630T1R0M: 电感值:1uH;精度:±20%;额定电流:10.73A;饱和电流(Isat):12.45A;类型:一体成型电感;; Manufacturer: APV(爱普微); Symbol: FEXL0520A-R80M; AddInBom: yes; ModelId: 6860c29aec394a38a0f014af7f722a42; ModelName: IND-SMD_L7.0-W6.6-H3.0; ModelTransform: 275.59,259.842,0,0,0,0,0,0,0; Tolerance: ±20%; Rated Current: 10.73A; Saturation Current (Isat): 12.45A; DC Resistance (DCR): 7.4mΩ; Type: 一体成型电感; Device: APH0630T1R0M; LCSC Part Name: 1uH ±20% 12.45A; SupplierPart: C5349700; ManufacturerPart: APH0630T1R0M; Supplier Footprint: SMD,7x6.6mm; JLCPCB Part Class: Extended Part; Datasheet: https://atta.szlcsc.com/upload/public/pdf/source/20230920/8DF4F91CA8787177DE496A10F73889DA.pdf; Supplier: LCSC; ConvertToPcb: yes; FootprintName: IND-SMD_L7.0-W6.6; Value: 1uH; Ratings: -
LED1-LED6 = KT-0603R: 发光颜色:红灯;二极管配置:-;透镜颜色:-;主波长:-;色温:-;功率:-;发光角度:-;安装方式:-;工作温度:-40℃~+85℃;; Manufacturer: KENTO; AddInBom: yes; ModelId: 1f0d29a91be547639d425604e9b96ebb; ModelTransform: 63.7794,32.283,0,0,0,0,0,0,0; Emitted Color: 红灯; Device: KT-0603R; Symbol: KT-0603R; LCSC Part Name: 0603 红灯 高亮; SupplierPart: C2286; ManufacturerPart: KT-0603R; Supplier Footprint: 0603; JLCPCB Part Class: Basic Part; Datasheet: https://atta.szlcsc.com/upload/public/pdf/source/20160616/1466072038404.pdf; Supplier: LCSC; ConvertToPcb: yes; FootprintName: LED0603-RD; ModelName: LED0603-RD; Diode Configuration: -; Lens Color: -; Dominant Wavelength: -; Peak Wavelength: -; Color Temperature: -; Forward Current: -; Power Dissipation: -; Viewing Angle: -; Mounting Sytle: -; Operating Temperature: -40℃~+85℃
M.2-1 M.2-2 = 91302-42-067RDM: Manufacturer: UMaxconn; NO_CONNECT: yes; ModelId: 5b95361101ad4f0b8f0e67de11f7038c; ModelName: PCIE-SMD_91302-XX-067RDM; ModelTransform: 860.234,267.33994,0,0,0,0,0,4.331,-19.685; Device: 91302-42-067RDM; AddInBom: yes; ConvertToPcb: yes; SymbolName: 91302-42-067RDM; LCSC Part Name: M.2 NGFF,高度4.2mm,M.2连接器,镀金30U,M Key,67PIN,卷装; SupplierPart: C601195; ManufacturerPart: 91302-42-067RDM; Supplier Footprint: SMD; JLCPCB Part Class: Extended Part; Datasheet: https://atta.szlcsc.com/upload/public/pdf/source/20210511/C1509730_FC1345B298657A7EB9D210DEA51B9F3C.pdf; Supplier: LCSC; FootprintName: conn-smd_91302-32-067rdm
Q1 Q2 = SS8550 Y2: 晶体管类型:PNP;集电极电流(Ic):1.5A;集射极击穿电压(Vceo):25V;功率(Pd):300mW;直流电流增益(hFE@Ic,Vce):200@100mA,1V;; Manufacturer: CJ(江苏长电/长晶); Symbol: MMBT3906LT1G; AddInBom: yes; ModelId: c62791f0466c4ae2a892c056b845b0ca; ModelName: SOT-23-3P_L2.9-W1.3-H1.0-LS2.4-P0.95; ModelTransform: 98.425,114.173,0,180,0,0,0.0005,-0.0005,0; Transistor Type: PNP; Collector Current (Ic): 1.5A; Collector-Emitter Breakdown Voltage (Vceo): 25V; Power Dissipation (Pd): 300mW; Transition Frequency (fT): 100MHz; Collector Cut-Off Current (Icbo): 100nA; Collector-Emitter Saturation Voltage (VCE(sat)@Ic,Ib): 500mV@800mA,80mA; Device: SS8550 Y2; Supplier: LCSC; Manufacturer Part: SS8550 Y2; Supplier Part: C8542; JLCPCB Part Class: Basic Part; LCSC Part Name: SS8550 Y2(RANGE:200-350) hfe=200~350; Supplier Footprint: SOT-23; Datasheet: https://atta.szlcsc.com/upload/public/pdf/source/20140809/1457707214734.pdf; ConvertToPcb: yes; FootprintName: SOT-23-3_L2.9-W1.3-P1.90-LS2.4-BR; DC Current Gain (hFE@Ic,Vce): 200@100mA,1V; Operating Temperature: -